# EasyEDA Pro project ProProject_IMUSensorNodes202312.epro, board 6_6_拼板20240123（带编号） (continued)
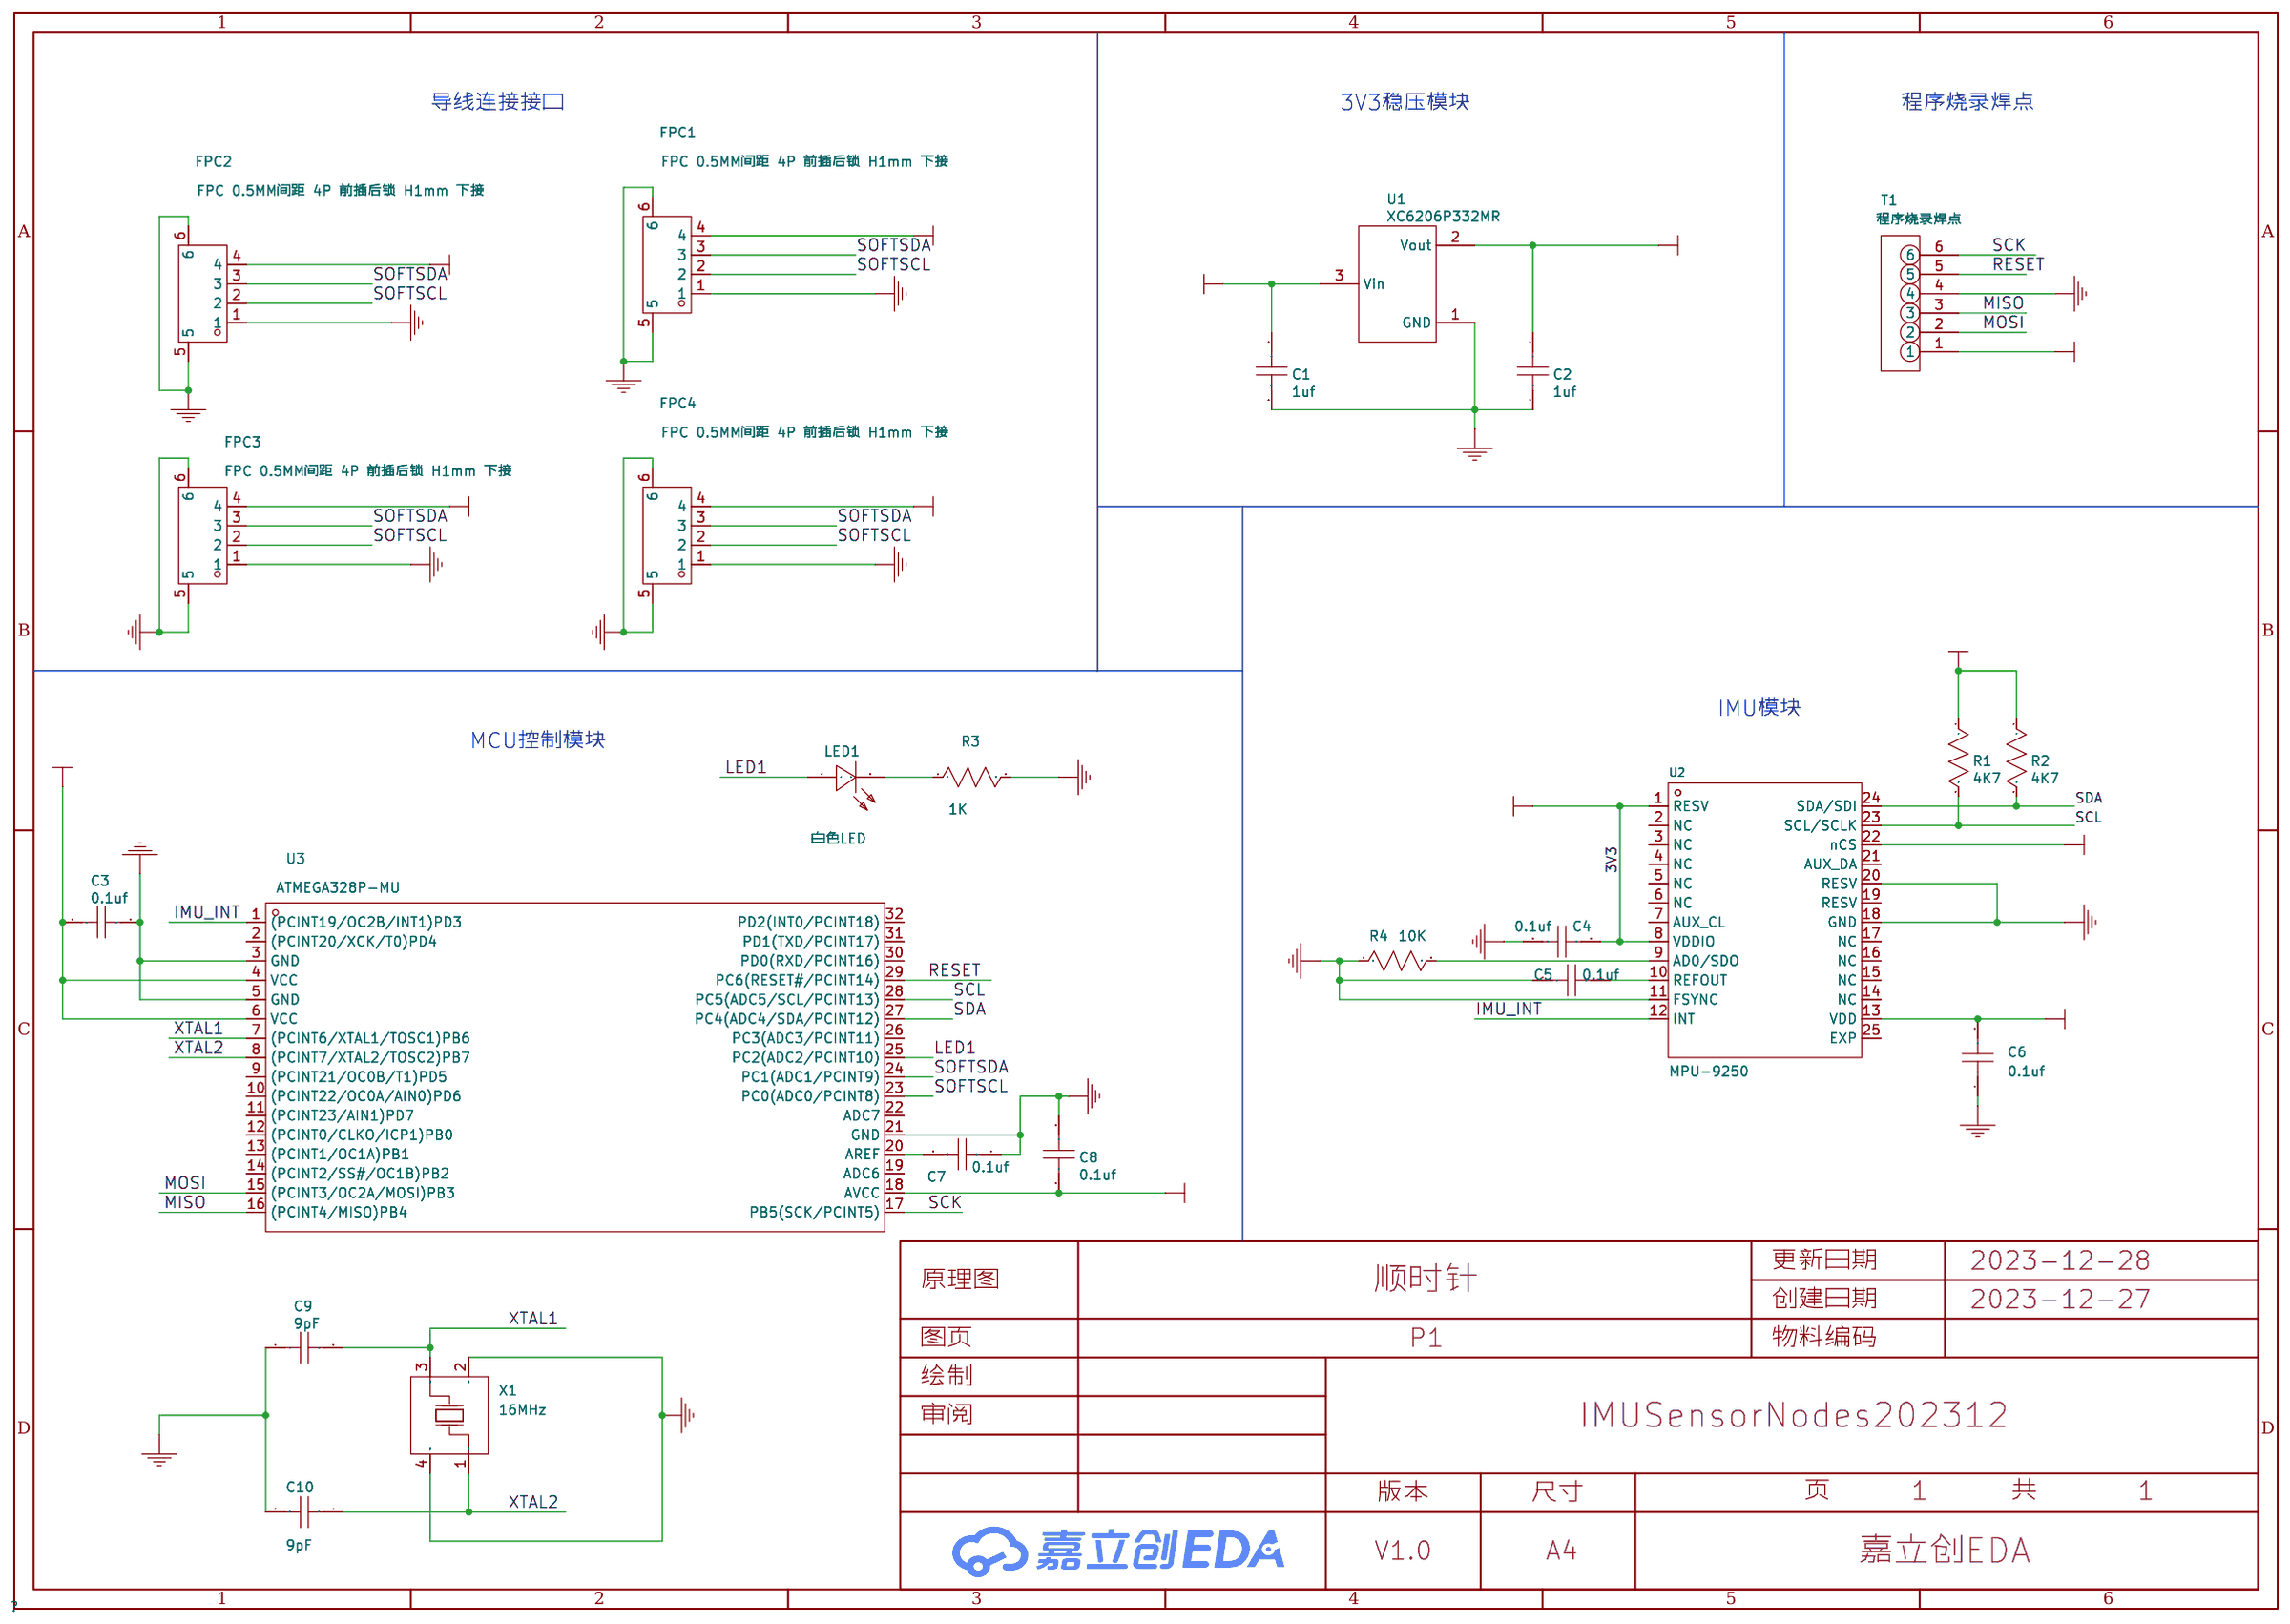
[diagram p0: schematic sheet]
## Placement (name value [footprint] x y rotation side) (continued)
Designator#453  -  [C0201]  24.03 32.92 0 bottom
Designator#454  -  [C0201]  21.49 33.68 180 bottom
Designator#455  -  [C0201]  18.06 28.22 0 bottom
Designator#456  -  [C0201]  21.49 31.27 180 bottom
Designator#457  -  [C0201]  15.91 35.72 180 bottom
Designator#458  -  [C0201]  23.27 36.86 0 bottom
Designator#459  -  [C0201]  22.89 38.13 180 bottom
Designator#460  -  [C0201]  21.75 38.38 0 bottom
Designator#461  -  [C0201]  20.99 36.73 180 bottom
Designator#462  -  [C0201]  15.91 34.83 0 bottom
Designator#463  -  [C0201]  37.5 32.92 0 bottom
Designator#464  -  [C0201]  34.96 33.81 180 bottom
Designator#465  -  [C0201]  31.65 28.35 0 bottom
Designator#466  -  [C0201]  35.08 31.27 180 bottom
Designator#467  -  [C0201]  29.5 35.59 180 bottom
Designator#468  -  [C0201]  36.86 36.73 0 bottom
Designator#469  -  [C0201]  36.48 38.13 180 bottom
Designator#470  -  [C0201]  35.21 38.38 0 bottom
Designator#471  -  [C0201]  34.7 36.73 180 bottom
Designator#472  -  [C0201]  29.5 34.7 0 bottom
Designator#473  -  [C0201]  51.34 32.92 0 bottom
Designator#474  -  [C0201]  48.8 33.68 180 bottom
Designator#475  -  [C0201]  45.37 28.22 0 bottom
Designator#476  -  [C0201]  48.8 31.27 180 bottom
Designator#477  -  [C0201]  43.21 35.72 180 bottom
Designator#478  -  [C0201]  50.58 36.86 0 bottom
Designator#479  -  [C0201]  50.2 38.13 180 bottom
Designator#480  -  [C0201]  49.05 38.38 0 bottom
Designator#481  -  [C0201]  48.29 36.73 180 bottom
Designator#482  -  [C0201]  43.21 34.83 0 bottom
Designator#483  -  [C0201]  64.8 32.92 0 bottom
Designator#484  -  [C0201]  62.26 33.81 180 bottom
Designator#485  -  [C0201]  58.96 28.35 0 bottom
Designator#486  -  [C0201]  62.39 31.27 180 bottom
Designator#487  -  [C0201]  56.8 35.59 180 bottom
Designator#488  -  [C0201]  64.17 36.73 0 bottom
Designator#489  -  [C0201]  63.78 38.13 180 bottom
Designator#490  -  [C0201]  62.51 38.38 0 bottom
Designator#491  -  [C0201]  62.01 36.73 180 bottom
Designator#492  -  [C0201]  56.8 34.7 0 bottom
Designator#493  -  [C0201]  78.64 32.92 0 bottom
Designator#494  -  [C0201]  76.1 33.68 180 bottom
Designator#495  -  [C0201]  72.67 28.22 0 bottom
Designator#496  -  [C0201]  76.1 31.27 180 bottom
Designator#497  -  [C0201]  70.52 35.72 180 bottom
Designator#498  -  [C0201]  77.88 36.86 0 bottom
Designator#499  -  [C0201]  77.5 38.13 180 bottom
Designator#500  -  [C0201]  76.36 38.38 0 bottom
Designator#501  -  [C0201]  75.6 36.73 180 bottom
Designator#502  -  [C0201]  70.52 34.83 0 bottom
Designator#503  -  [C0201]  78.64 74.07 0 bottom
Designator#504  -  [C0201]  76.1 74.83 180 bottom
Designator#505  -  [C0201]  72.67 69.37 0 bottom
Designator#506  -  [C0201]  76.1 72.42 180 bottom
Designator#507  -  [C0201]  70.52 76.86 180 bottom
Designator#508  -  [C0201]  77.88 78.01 0 bottom
Designator#509  -  [C0201]  77.5 79.28 180 bottom
Designator#510  -  [C0201]  76.36 79.53 0 bottom
Designator#511  -  [C0201]  75.6 77.88 180 bottom
Designator#512  -  [C0201]  70.52 75.97 0 bottom
Designator#513  -  [C0201]  10.19 19.21 0 bottom
Designator#514  -  [C0201]  7.65 20.09 180 bottom
Designator#515  -  [C0201]  4.35 14.63 0 bottom
Designator#516  -  [C0201]  7.78 17.56 180 bottom
Designator#517  -  [C0201]  2.19 21.87 180 bottom
Designator#518  -  [C0201]  9.56 23.02 0 bottom
Designator#519  -  [C0201]  9.17 24.41 180 bottom
Designator#520  -  [C0201]  7.91 24.67 0 bottom
Designator#521  -  [C0201]  7.4 23.02 180 bottom
Designator#522  -  [C0201]  2.19 20.98 0 bottom
Designator#523  -  [C0201]  24.03 19.21 0 bottom
Designator#524  -  [C0201]  21.49 19.97 180 bottom
Designator#525  -  [C0201]  18.06 14.51 0 bottom
Designator#526  -  [C0201]  21.49 17.56 180 bottom
Designator#527  -  [C0201]  15.91 22 180 bottom
Designator#528  -  [C0201]  23.27 23.14 0 bottom
Designator#529  -  [C0201]  22.89 24.41 180 bottom
Designator#530  -  [C0201]  21.75 24.67 0 bottom
Designator#531  -  [C0201]  20.99 23.02 180 bottom
Designator#532  -  [C0201]  15.91 21.11 0 bottom
Designator#533  -  [C0201]  37.5 19.21 0 bottom
Designator#534  -  [C0201]  34.96 20.09 180 bottom
Designator#535  -  [C0201]  31.65 14.63 0 bottom
Designator#536  -  [C0201]  35.08 17.56 180 bottom
Designator#537  -  [C0201]  29.5 21.87 180 bottom
Designator#538  -  [C0201]  36.86 23.02 0 bottom
Designator#539  -  [C0201]  36.48 24.41 180 bottom
Designator#540  -  [C0201]  35.21 24.67 0 bottom
Designator#541  -  [C0201]  34.7 23.02 180 bottom
Designator#542  -  [C0201]  29.5 20.98 0 bottom
Designator#543  -  [C0201]  51.34 19.21 0 bottom
Designator#544  -  [C0201]  48.8 19.97 180 bottom
Designator#545  -  [C0201]  45.37 14.51 0 bottom
Designator#546  -  [C0201]  48.8 17.56 180 bottom
Designator#547  -  [C0201]  43.21 22 180 bottom
Designator#548  -  [C0201]  62.51 79.53 0 bottom
Designator#549  -  [C0201]  50.58 23.14 0 bottom
Designator#550  -  [C0201]  50.2 24.41 180 bottom
Designator#551  -  [C0201]  49.05 24.67 0 bottom
Designator#552  -  [C0201]  48.29 23.02 180 bottom
Designator#553  -  [C0201]  43.21 21.11 0 bottom
Designator#554  -  [C0201]  64.8 19.21 0 bottom
Designator#555  -  [C0201]  62.26 20.09 180 bottom
Designator#556  -  [C0201]  58.96 14.63 0 bottom
Designator#557  -  [C0201]  62.39 17.56 180 bottom
Designator#558  -  [C0201]  56.8 21.87 180 bottom
Designator#559  -  [C0201]  62.51 24.67 0 bottom
Designator#560  -  [C0201]  62.01 23.02 180 bottom
Designator#561  -  [C0201]  56.8 20.98 0 bottom
Designator#562  -  [C0201]  78.64 19.21 0 bottom
Designator#563  -  [C0201]  76.1 19.97 180 bottom
Designator#564  -  [C0201]  72.67 14.51 0 bottom
Designator#565  -  [C0201]  76.1 17.56 180 bottom
Designator#566  -  [C0201]  70.52 22 180 bottom
Designator#567  -  [C0201]  10.19 5.49 0 bottom
Designator#568  -  [C0201]  7.65 6.38 180 bottom
Designator#569  -  [C0201]  4.35 0.92 0 bottom
Designator#570  -  [C0201]  7.78 3.84 180 bottom
Designator#571  -  [C0201]  2.19 8.16 180 bottom
Designator#572  -  [C0201]  9.56 9.3 0 bottom
Designator#573  -  [C0201]  9.17 10.7 180 bottom
Designator#574  -  [C0201]  7.91 10.95 0 bottom
Designator#575  -  [C0201]  7.4 9.3 180 bottom
Designator#576  -  [C0201]  2.19 7.27 0 bottom
Designator#577  -  [C0201]  24.03 5.49 0 bottom
Designator#578  -  [C0201]  21.49 6.25 180 bottom
Designator#579  -  [C0201]  18.06 0.79 0 bottom
Designator#580  -  [C0201]  21.49 3.84 180 bottom
Designator#581  -  [C0201]  15.91 8.28 180 bottom
Designator#582  -  [C0201]  23.27 9.43 0 bottom
Designator#583  -  [C0201]  22.89 10.7 180 bottom
Designator#584  -  [C0201]  21.75 10.95 0 bottom
Designator#585  -  [C0201]  20.99 9.3 180 bottom
Designator#586  -  [C0201]  15.91 7.4 0 bottom
Designator#587  -  [C0201]  37.5 5.49 0 bottom
Designator#588  -  [C0201]  34.96 6.38 180 bottom
Designator#589  -  [C0201]  31.65 0.92 0 bottom
Designator#590  -  [C0201]  35.08 3.84 180 bottom
Designator#591  -  [C0201]  29.5 8.16 180 bottom
Designator#592  -  [C0201]  36.86 9.3 0 bottom
Designator#593  -  [C0201]  36.48 10.7 180 bottom
Designator#594  -  [C0201]  35.21 10.95 0 bottom
Designator#595  -  [C0201]  34.7 9.3 180 bottom
Designator#596  -  [C0201]  29.5 7.27 0 bottom
Designator#597  -  [C0201]  51.34 5.49 0 bottom
Designator#598  -  [C0201]  48.8 6.25 180 bottom
Designator#599  -  [C0201]  45.37 0.79 0 bottom
Designator#600  -  [C0201]  48.8 3.84 180 bottom
Designator#601  -  [C0201]  43.21 8.28 180 bottom
Designator#602  -  [C0201]  50.58 9.43 0 bottom
Designator#603  -  [C0201]  50.2 10.7 180 bottom
Designator#604  -  [C0201]  49.05 10.95 0 bottom
Designator#605  -  [C0201]  48.29 9.3 180 bottom
Designator#606  -  [C0201]  43.21 7.4 0 bottom
Designator#607  -  [C0201]  64.8 5.49 0 bottom
Designator#608  -  [C0201]  62.26 6.38 180 bottom
Designator#609  -  [C0201]  58.96 0.92 0 bottom
Designator#610  -  [C0201]  62.39 3.84 180 bottom
Designator#611  -  [C0201]  56.8 8.16 180 bottom
Designator#612  -  [C0201]  64.17 9.3 0 bottom
Designator#613  -  [C0201]  63.78 10.7 180 bottom
Designator#614  -  [C0201]  62.51 10.95 0 bottom
Designator#615  -  [C0201]  62.01 9.3 180 bottom
Designator#616  -  [C0201]  56.8 7.27 0 bottom
Designator#617  -  [C0201]  78.64 5.49 0 bottom
Designator#618  -  [C0201]  76.1 6.25 180 bottom
Designator#619  -  [C0201]  72.67 0.79 0 bottom
Designator#620  -  [C0201]  76.1 3.84 180 bottom
Designator#621  -  [C0201]  70.52 8.28 180 bottom
Designator#622  -  [C0201]  77.88 9.43 0 bottom
Designator#623  -  [C0201]  77.5 10.7 180 bottom
Designator#624  -  [C0201]  76.36 10.95 0 bottom
Designator#625  -  [C0201]  75.6 9.3 180 bottom
Designator#626  -  [C0201]  70.52 7.4 0 bottom
Designator#627  -  [C0201]  10.19 74.07 0 bottom
Designator#628  -  [C0201]  7.65 74.96 180 bottom
Designator#629  -  [C0201]  4.35 69.5 0 bottom
Designator#630  -  [C0201]  7.78 72.42 180 bottom
Designator#631  -  [C0201]  2.19 76.74 180 bottom
Designator#632  -  [C0201]  9.56 77.88 0 bottom
Designator#633  -  [C0201]  9.17 79.28 180 bottom
Designator#634  -  [C0201]  7.91 79.53 0 bottom
Designator#635  -  [C0201]  7.4 77.88 180 bottom
Designator#636  -  [C0201]  2.19 75.85 0 bottom
Designator#637  -  [C0201]  64.8 74.07 0 bottom
Designator#638  -  [C0201]  62.26 74.96 180 bottom
Designator#639  -  [C0201]  58.96 69.5 0 bottom
Designator#640  -  [C0201]  62.39 72.42 180 bottom
Designator#641  -  [C0201]  56.8 76.74 180 bottom
Designator#642  -  [C0201]  64.17 77.88 0 bottom
Designator#643  -  [C0201]  24.03 74.07 0 bottom
Designator#644  -  [C0201]  21.49 74.83 180 bottom
Designator#645  -  [C0201]  18.06 69.37 0 bottom
Designator#646  -  [C0201]  21.49 72.42 180 bottom
Designator#647  -  [C0201]  15.91 76.86 180 bottom
Designator#648  -  [C0201]  63.78 79.28 180 bottom
Designator#649  -  [C0201]  23.27 78.01 0 bottom
Designator#650  -  [C0201]  22.89 79.28 180 bottom
Designator#651  -  [C0201]  21.75 79.53 0 bottom
Designator#652  -  [C0201]  20.99 77.88 180 bottom
Designator#653  -  [C0201]  15.91 75.97 0 bottom
Designator#654  -  [C0201]  62.01 77.88 180 bottom
Designator#655  -  [C0201]  56.8 75.85 0 bottom
Designator#656  -  [C0201]  37.5 74.07 0 bottom
Designator#657  -  [C0201]  34.96 74.96 180 bottom
Designator#658  -  [C0201]  31.65 69.5 0 bottom
Designator#659  -  [C0201]  35.08 72.42 180 bottom
Designator#660  -  [C0201]  29.5 76.74 180 bottom
Designator#661  -  [C0201]  36.86 77.88 0 bottom
Designator#662  -  [C0201]  36.48 79.28 180 bottom
Designator#663  -  [C0201]  35.21 79.53 0 bottom
Designator#664  -  [C0201]  34.7 77.88 180 bottom
Designator#665  -  [C0201]  29.5 75.85 0 bottom
Designator#666  -  [C0201]  51.34 74.07 0 bottom
Designator#667  -  [C0201]  48.8 74.83 180 bottom
Designator#668  -  [C0201]  45.37 69.37 0 bottom
Designator#669  -  [C0201]  48.8 72.42 180 bottom
Designator#670  -  [C0201]  43.21 76.86 180 bottom
Designator#671  -  [C0201]  50.58 78.01 0 bottom
Designator#672  -  [C0201]  50.2 79.28 180 bottom
Designator#673  -  [C0201]  49.05 79.53 0 bottom
Designator#674  -  [C0201]  48.29 77.88 180 bottom
Designator#675  -  [C0201]  43.21 75.97 0 bottom
Designator#676  -  [C0201]  10.19 60.35 0 bottom
Designator#677  -  [C0201]  7.65 61.24 180 bottom
Designator#678  -  [C0201]  4.35 55.78 0 bottom
Designator#679  -  [C0201]  7.78 58.7 180 bottom
Designator#680  -  [C0201]  2.19 63.02 180 bottom
Designator#681  -  [C0201]  9.56 64.16 0 bottom
Designator#682  -  [C0201]  9.17 65.56 180 bottom
Designator#683  -  [C0201]  7.91 65.81 0 bottom
Designator#684  -  [C0201]  7.4 64.16 180 bottom
Designator#685  -  [C0201]  2.19 62.13 0 bottom
Designator#686  -  [C0201]  24.03 60.35 0 bottom
Designator#687  -  [C0201]  21.49 61.12 180 bottom
Designator#688  -  [C0201]  18.06 55.66 0 bottom
Designator#689  -  [C0201]  21.49 58.7 180 bottom
Designator#690  -  [C0201]  15.91 63.15 180 bottom
Designator#691  -  [C0201]  23.27 64.29 0 bottom
Designator#692  -  [C0201]  22.89 65.56 180 bottom
Designator#693  -  [C0201]  21.75 65.81 0 bottom
Designator#694  -  [C0201]  20.99 64.16 180 bottom
Designator#695  -  [C0201]  15.91 62.26 0 bottom
Designator#696  -  [C0201]  37.5 60.35 0 bottom
Designator#697  -  [C0201]  34.96 61.24 180 bottom
Designator#698  -  [C0201]  31.65 55.78 0 bottom
Designator#699  -  [C0201]  35.08 58.7 180 bottom
Designator#700  -  [C0201]  29.5 63.02 180 bottom
Designator#701  -  [C0201]  36.86 64.16 0 bottom
Designator#702  -  [C0201]  36.48 65.56 180 bottom
Designator#703  -  [C0201]  35.21 65.81 0 bottom
Designator#704  -  [C0201]  34.7 64.16 180 bottom
Designator#705  -  [C0201]  29.5 62.13 0 bottom
Designator#706  -  [C0201]  51.34 60.35 0 bottom
Designator#707  -  [C0201]  48.8 61.12 180 bottom
Designator#708  -  [C0201]  45.37 55.66 0 bottom
Designator#709  -  [C0201]  48.8 58.7 180 bottom
Designator#710  -  [C0201]  43.21 63.15 180 bottom
Designator#711  -  [C0201]  50.58 64.29 0 bottom
Designator#712  -  [C0201]  50.2 65.56 180 bottom
Designator#713  -  [C0201]  49.05 65.81 0 bottom
Designator#714  -  [C0201]  48.29 64.16 180 bottom
Designator#715  -  [C0201]  43.21 62.26 0 bottom
Designator#716  -  [C0201]  64.8 60.35 0 bottom
Designator#717  -  [C0201]  62.26 61.24 180 bottom
Designator#718  -  [C0201]  58.96 55.78 0 bottom
Designator#719  -  [C0201]  62.39 58.7 180 bottom
Designator#720  -  [C0201]  56.8 63.02 180 bottom
Designator#721  -  [C0201]  64.17 64.16 0 bottom
Designator#722  -  [C0201]  63.78 65.56 180 bottom
Designator#723  -  [C0201]  62.51 65.81 0 bottom
Designator#724  -  [C0201]  62.01 64.16 180 bottom
Designator#725  -  [C0201]  56.8 62.13 0 bottom
Designator#726  -  [C0201]  78.64 60.35 0 bottom
Designator#727  -  [C0201]  76.1 61.12 180 bottom
Designator#728  -  [C0201]  72.67 55.66 0 bottom
Designator#729  -  [C0201]  76.1 58.7 180 bottom
Designator#730  -  [C0201]  70.52 63.15 180 bottom
Designator#731  -  [C0201]  77.88 64.29 0 bottom
Designator#732  -  [C0201]  77.5 65.56 180 bottom
Designator#733  -  [C0201]  76.36 65.81 0 bottom
Designator#734  -  [C0201]  75.6 64.16 180 bottom
Designator#735  -  [C0201]  70.52 62.26 0 bottom
Designator#736  -  [C0201]  10.19 46.64 0 bottom
Designator#737  -  [C0201]  7.65 47.53 180 bottom
Designator#738  -  [C0201]  4.35 42.07 0 bottom
Designator#739  -  [C0201]  7.78 44.99 180 bottom
Designator#740  -  [C0201]  2.19 49.3 180 bottom
Designator#741  -  [C0201]  9.56 50.45 0 bottom
Designator#742  -  [C0201]  9.17 51.84 180 bottom
Designator#743  -  [C0201]  7.91 52.1 0 bottom
Designator#744  -  [C0201]  7.4 50.45 180 bottom
Designator#745  -  [C0201]  2.19 48.42 0 bottom
Designator#746  -  [C0201]  24.03 46.64 0 bottom
Designator#747  -  [C0201]  21.49 47.4 180 bottom
Designator#748  -  [C0201]  18.06 41.94 0 bottom
Designator#749  -  [C0201]  21.49 44.99 180 bottom
Designator#750  -  [C0201]  15.91 49.43 180 bottom
Designator#751  -  [C0201]  23.27 50.58 0 bottom
Designator#752  -  [C0201]  22.89 51.84 180 bottom
Designator#753  -  [C0201]  21.75 52.1 0 bottom
Designator#754  -  [C0201]  20.99 50.45 180 bottom
Designator#755  -  [C0201]  15.91 48.54 0 bottom
Designator#756  -  [C0201]  37.5 46.64 0 bottom
Designator#757  -  [C0201]  34.96 47.53 180 bottom
Designator#758  -  [C0201]  31.65 42.07 0 bottom
Designator#759  -  [C0201]  35.08 44.99 180 bottom
Designator#760  -  [C0201]  29.5 49.3 180 bottom
Designator#761  -  [C0201]  36.86 50.45 0 bottom
Designator#762  -  [C0201]  36.48 51.84 180 bottom
Designator#763  -  [C0201]  35.21 52.1 0 bottom
Designator#764  -  [C0201]  34.7 50.45 180 bottom
Designator#765  -  [C0201]  29.5 48.42 0 bottom
Designator#766  -  [C0201]  51.34 46.64 0 bottom
Designator#767  -  [C0201]  48.8 47.4 180 bottom
Designator#768  -  [C0201]  45.37 41.94 0 bottom
Designator#769  -  [C0201]  48.8 44.99 180 bottom
Designator#770  -  [C0201]  43.21 49.43 180 bottom
Designator#771  -  [C0201]  50.58 50.58 0 bottom
Designator#772  -  [C0201]  50.2 51.84 180 bottom
Designator#773  -  [C0201]  49.05 52.1 0 bottom
Designator#774  -  [C0201]  48.29 50.45 180 bottom
Designator#775  -  [C0201]  43.21 48.54 0 bottom
Designator#776  -  [C0201]  64.8 46.64 0 bottom
Designator#777  -  [C0201]  62.26 47.53 180 bottom
Designator#778  -  [C0201]  58.96 42.07 0 bottom
Designator#779  -  [C0201]  62.39 44.99 180 bottom
Designator#780  -  [C0201]  56.8 49.3 180 bottom
Designator#781  -  [C0201]  64.17 50.45 0 bottom
Designator#782  -  [C0201]  63.78 51.84 180 bottom
Designator#783  -  [C0201]  62.51 52.1 0 bottom
Designator#784  -  [C0201]  62.01 50.45 180 bottom
Designator#785  -  [C0201]  56.8 48.42 0 bottom
Designator#786  -  [C0201]  78.64 46.64 0 bottom
Designator#787  -  [C0201]  76.1 47.4 180 bottom
Designator#788  -  [C0201]  72.67 41.94 0 bottom
Designator#789  -  [C0201]  76.1 44.99 180 bottom
Designator#790  -  [C0201]  70.52 49.43 180 bottom
Designator#791  -  [C0201]  77.88 50.58 0 bottom
Designator#792  -  [C0201]  77.5 51.84 180 bottom
Designator#793  -  [C0201]  76.36 52.1 0 bottom
Designator#794  -  [C0201]  75.6 50.45 180 bottom
Designator#795  -  [C0201]  70.52 48.54 0 bottom
Designator#796  -  [C0201]  10.19 32.92 0 bottom
Designator#797  -  [C0201]  7.65 33.81 180 bottom
Designator#798  -  [C0201]  4.35 28.35 0 bottom
Designator#799  -  [C0201]  7.78 31.27 180 bottom
Designator#800  -  [C0201]  2.19 35.59 180 bottom
Designator#801  -  [vqfn-32_l5.0-w5.0-p0.50-tl-ep3.1#2]  72.67 31.4 270 bottom
Designator#802  -  [test]  36.71 72.98 270 bottom
Designator#803  -  [vqfn-32_l5.0-w5.0-p0.50-tl-ep3.1]  4.35 45.11 270 bottom
Designator#804  -  [test]  77.73 4.4 270 bottom
Designator#805  -  [test]  36.71 45.54 270 bottom
Designator#806  -  [vqfn-32_l5.0-w5.0-p0.50-tl-ep3.1]  31.65 3.97 270 bottom
Designator#807  -  [test]  64.01 45.54 270 bottom
Designator#808  -  [vqfn-32_l5.0-w5.0-p0.50-tl-ep3.1]  31.65 58.83 270 bottom
Designator#809  -  [vqfn-32_l5.0-w5.0-p0.50-tl-ep3.1#2]  72.67 58.83 270 bottom
Designator#810  -  [vqfn-32_l5.0-w5.0-p0.50-tl-ep3.1#2]  72.67 72.55 270 bottom
Designator#811  -  [vqfn-32_l5.0-w5.0-p0.50-tl-ep3.1]  4.35 58.83 270 bottom
Designator#812  -  [test]  9.4 45.54 270 bottom
Designator#813  -  [qfn-24_l3.0-w3.0-p0.40-bl-ep]  45.62 23.14 0 bottom
Designator#814  -  [qfn-24_l3.0-w3.0-p0.40-bl-ep#2]  59.21 78.01 0 bottom
Designator#815  -  [test]  36.71 31.83 270 bottom
Designator#816  -  [test]  50.42 31.83 270 bottom
Designator#817  -  [test]  77.73 18.11 270 bottom
Designator#818  -  [qfn-24_l3.0-w3.0-p0.40-bl-ep#2]  4.6 64.29 0 bottom
Designator#819  -  [qfn-24_l3.0-w3.0-p0.40-bl-ep#2]  59.21 64.29 0 bottom
Designator#820  -  [vqfn-32_l5.0-w5.0-p0.50-tl-ep3.1#2]  18.06 72.55 270 bottom
Designator#821  -  [test]  64.01 59.26 270 bottom
Designator#822  -  [vqfn-32_l5.0-w5.0-p0.50-tl-ep3.1#2]  18.06 31.4 270 bottom
Designator#823  -  [test]  36.71 4.4 270 bottom
Designator#824  -  [test]  36.71 18.11 270 bottom
Designator#825  -  [test]  64.01 72.98 270 bottom
Designator#826  -  [qfn-24_l3.0-w3.0-p0.40-bl-ep]  72.93 9.43 0 bottom
Designator#827  -  [vqfn-32_l5.0-w5.0-p0.50-tl-ep3.1]  31.65 31.4 270 bottom
Designator#828  -  [test]  64.01 31.83 270 bottom
Designator#829  -  [vqfn-32_l5.0-w5.0-p0.50-tl-ep3.1]  58.96 17.68 270 bottom
Designator#830  -  [qfn-24_l3.0-w3.0-p0.40-bl-ep]  72.93 36.86 0 bottom
Designator#831  -  [qfn-24_l3.0-w3.0-p0.40-bl-ep#2]  31.91 9.43 0 bottom
Designator#832  -  [vqfn-32_l5.0-w5.0-p0.50-tl-ep3.1]  58.96 3.97 270 bottom
Designator#833  -  [test]  23.12 45.54 270 bottom
Designator#834  -  [test]  36.71 59.26 270 bottom
Designator#835  -  [vqfn-32_l5.0-w5.0-p0.50-tl-ep3.1#2]  18.06 58.83 270 bottom
Designator#836  -  [qfn-24_l3.0-w3.0-p0.40-bl-ep]  18.32 23.14 0 bottom
Designator#837  -  [vqfn-32_l5.0-w5.0-p0.50-tl-ep3.1]  4.35 17.68 270 bottom
Designator#838  -  [vqfn-32_l5.0-w5.0-p0.50-tl-ep3.1#2]  45.37 3.97 270 bottom
Designator#839  -  [vqfn-32_l5.0-w5.0-p0.50-tl-ep3.1#2]  45.37 31.4 270 bottom
Designator#840  -  [SOT-23-3_L2.9-W1.6-P1.90-LS2.8-BR]  23.4 34.95 0 bottom
Designator#841  -  [SOT-23-3_L2.9-W1.6-P1.90-LS2.8-BR]  37.12 34.95 0 bottom
Designator#842  -  [SOT-23-3_L2.9-W1.6-P1.90-LS2.8-BR]  50.7 34.95 0 bottom
Designator#843  -  [SOT-23-3_L2.9-W1.6-P1.90-LS2.8-BR]  64.42 34.95 0 bottom
Designator#844  -  [SOT-23-3_L2.9-W1.6-P1.90-LS2.8-BR]  78.01 34.95 0 bottom
Designator#845  -  [SOT-23-3_L2.9-W1.6-P1.90-LS2.8-BR]  78.01 76.1 0 bottom
Designator#846  -  [SOT-23-3_L2.9-W1.6-P1.90-LS2.8-BR]  9.81 21.24 0 bottom
Designator#847  -  [SOT-23-3_L2.9-W1.6-P1.90-LS2.8-BR]  23.4 21.24 0 bottom
Designator#848  -  [SOT-23-3_L2.9-W1.6-P1.90-LS2.8-BR]  37.12 21.24 0 bottom
Designator#849  -  [SOT-23-3_L2.9-W1.6-P1.90-LS2.8-BR]  50.7 21.24 0 bottom
Designator#850  -  [SOT-23-3_L2.9-W1.6-P1.90-LS2.8-BR]  64.42 21.24 0 bottom
Designator#851  -  [SOT-23-3_L2.9-W1.6-P1.90-LS2.8-BR]  78.01 21.24 0 bottom
Designator#852  -  [SOT-23-3_L2.9-W1.6-P1.90-LS2.8-BR]  9.81 7.52 0 bottom
Designator#853  -  [SOT-23-3_L2.9-W1.6-P1.90-LS2.8-BR]  23.4 7.52 0 bottom
Designator#854  -  [SOT-23-3_L2.9-W1.6-P1.90-LS2.8-BR]  37.12 7.52 0 bottom
Designator#855  -  [SOT-23-3_L2.9-W1.6-P1.90-LS2.8-BR]  50.7 7.52 0 bottom
Designator#856  -  [SOT-23-3_L2.9-W1.6-P1.90-LS2.8-BR]  64.42 7.52 0 bottom
Designator#857  -  [SOT-23-3_L2.9-W1.6-P1.90-LS2.8-BR]  78.01 7.52 0 bottom
Designator#858  -  [SOT-23-3_L2.9-W1.6-P1.90-LS2.8-BR]  9.81 76.1 0 bottom
Designator#859  -  [SOT-23-3_L2.9-W1.6-P1.90-LS2.8-BR]  64.42 76.1 0 bottom
Designator#860  -  [SOT-23-3_L2.9-W1.6-P1.90-LS2.8-BR]  23.4 76.1 0 bottom
Designator#861  -  [SOT-23-3_L2.9-W1.6-P1.90-LS2.8-BR]  37.12 76.1 0 bottom
Designator#862  -  [SOT-23-3_L2.9-W1.6-P1.90-LS2.8-BR]  50.7 76.1 0 bottom
Designator#863  -  [SOT-23-3_L2.9-W1.6-P1.90-LS2.8-BR]  9.81 62.39 0 bottom
Designator#864  -  [SOT-23-3_L2.9-W1.6-P1.90-LS2.8-BR]  23.4 62.39 0 bottom
Designator#865  -  [SOT-23-3_L2.9-W1.6-P1.90-LS2.8-BR]  37.12 62.39 0 bottom
Designator#866  -  [SOT-23-3_L2.9-W1.6-P1.90-LS2.8-BR]  50.7 62.39 0 bottom
Designator#867  -  [SOT-23-3_L2.9-W1.6-P1.90-LS2.8-BR]  64.42 62.39 0 bottom
Designator#868  -  [SOT-23-3_L2.9-W1.6-P1.90-LS2.8-BR]  78.01 62.39 0 bottom
Designator#869  -  [SOT-23-3_L2.9-W1.6-P1.90-LS2.8-BR]  9.81 48.67 0 bottom
Designator#870  -  [SOT-23-3_L2.9-W1.6-P1.90-LS2.8-BR]  23.4 48.67 0 bottom
Designator#871  -  [SOT-23-3_L2.9-W1.6-P1.90-LS2.8-BR]  37.12 48.67 0 bottom
Designator#872  -  [SOT-23-3_L2.9-W1.6-P1.90-LS2.8-BR]  50.7 48.67 0 bottom
Designator#873  -  [SOT-23-3_L2.9-W1.6-P1.90-LS2.8-BR]  64.42 48.67 0 bottom
Designator#874  -  [SOT-23-3_L2.9-W1.6-P1.90-LS2.8-BR]  78.01 48.67 0 bottom
Designator#875  -  [SOT-23-3_L2.9-W1.6-P1.90-LS2.8-BR]  9.81 34.95 0 bottom
Designator#876  -  [test]  23.12 72.98 270 bottom
Designator#877  -  [qfn-24_l3.0-w3.0-p0.40-bl-ep#2]  59.21 50.58 0 bottom
Designator#878  -  [qfn-24_l3.0-w3.0-p0.40-bl-ep#2]  31.91 64.29 0 bottom
Designator#879  -  [test]  77.73 72.98 270 bottom
Designator#880  -  [qfn-24_l3.0-w3.0-p0.40-bl-ep]  45.62 78.01 0 bottom
Designator#881  -  [qfn-24_l3.0-w3.0-p0.40-bl-ep]  72.93 64.29 0 bottom
Designator#882  -  [qfn-24_l3.0-w3.0-p0.40-bl-ep]  45.62 36.86 0 bottom
Designator#883  -  [qfn-24_l3.0-w3.0-p0.40-bl-ep]  72.93 23.14 0 bottom
Designator#884  -  [test]  50.42 72.98 270 bottom
Designator#885  -  [vqfn-32_l5.0-w5.0-p0.50-tl-ep3.1#2]  45.37 17.68 270 bottom
Designator#886  -  [qfn-24_l3.0-w3.0-p0.40-bl-ep]  18.32 78.01 0 bottom
Designator#887  -  [test]  64.01 4.4 270 bottom
Designator#888  -  [qfn-24_l3.0-w3.0-p0.40-bl-ep#2]  4.6 50.58 0 bottom
Designator#889  -  [vqfn-32_l5.0-w5.0-p0.50-tl-ep3.1#2]  45.37 72.55 270 bottom
Designator#890  -  [qfn-24_l3.0-w3.0-p0.40-bl-ep]  18.32 50.58 0 bottom
Designator#891  -  [test]  64.01 18.11 270 bottom
Designator#892  -  [vqfn-32_l5.0-w5.0-p0.50-tl-ep3.1]  58.96 31.4 270 bottom
Designator#893  -  [test]  9.4 18.11 270 bottom
Designator#894  -  [test]  50.42 4.4 270 bottom
Designator#895  -  [vqfn-32_l5.0-w5.0-p0.50-tl-ep3.1#2]  72.67 17.68 270 bottom
Designator#896  -  [vqfn-32_l5.0-w5.0-p0.50-tl-ep3.1]  58.96 58.83 270 bottom
Designator#897  -  [qfn-24_l3.0-w3.0-p0.40-bl-ep]  45.62 50.58 0 bottom
Designator#898  -  [test]  9.4 31.83 270 bottom
Designator#899  -  [test]  77.73 45.54 270 bottom
Designator#900  -  [qfn-24_l3.0-w3.0-p0.40-bl-ep#2]  59.21 23.14 0 bottom
Designator#901  -  [qfn-24_l3.0-w3.0-p0.40-bl-ep#2]  31.91 78.01 0 bottom
Designator#902  -  [vqfn-32_l5.0-w5.0-p0.50-tl-ep3.1#2]  18.06 45.11 270 bottom
Designator#903  -  [vqfn-32_l5.0-w5.0-p0.50-tl-ep3.1]  58.96 72.55 270 bottom
Designator#904  -  [vqfn-32_l5.0-w5.0-p0.50-tl-ep3.1#2]  18.06 17.68 270 bottom
Designator#905  -  [test]  23.12 4.4 270 bottom
Designator#906  -  [vqfn-32_l5.0-w5.0-p0.50-tl-ep3.1#2]  72.67 45.11 270 bottom
Designator#907  -  [test]  50.42 59.26 270 bottom
Designator#908  -  [test]  9.4 72.98 270 bottom
Designator#909  -  [qfn-24_l3.0-w3.0-p0.40-bl-ep#2]  31.91 23.14 0 bottom
Designator#910  -  [vqfn-32_l5.0-w5.0-p0.50-tl-ep3.1#2]  72.67 3.97 270 bottom
Designator#911  -  [qfn-24_l3.0-w3.0-p0.40-bl-ep#2]  59.21 9.43 0 bottom
Designator#912  -  [qfn-24_l3.0-w3.0-p0.40-bl-ep]  72.93 50.58 0 bottom
